# EasyEDA Pro project Zero_PCB_JLCEDA.eprj, schematic Zero_PCB
Create Date: 2023-06-04; Page Name: Zero_PCB; Project Name: Zero_PCB_JLCEDA; Schematic Name: Zero_PCB; Update Date: 2023-07-14; Company: xddcore; Drawed: xddcore; Page Size: A1; Version: V1.1
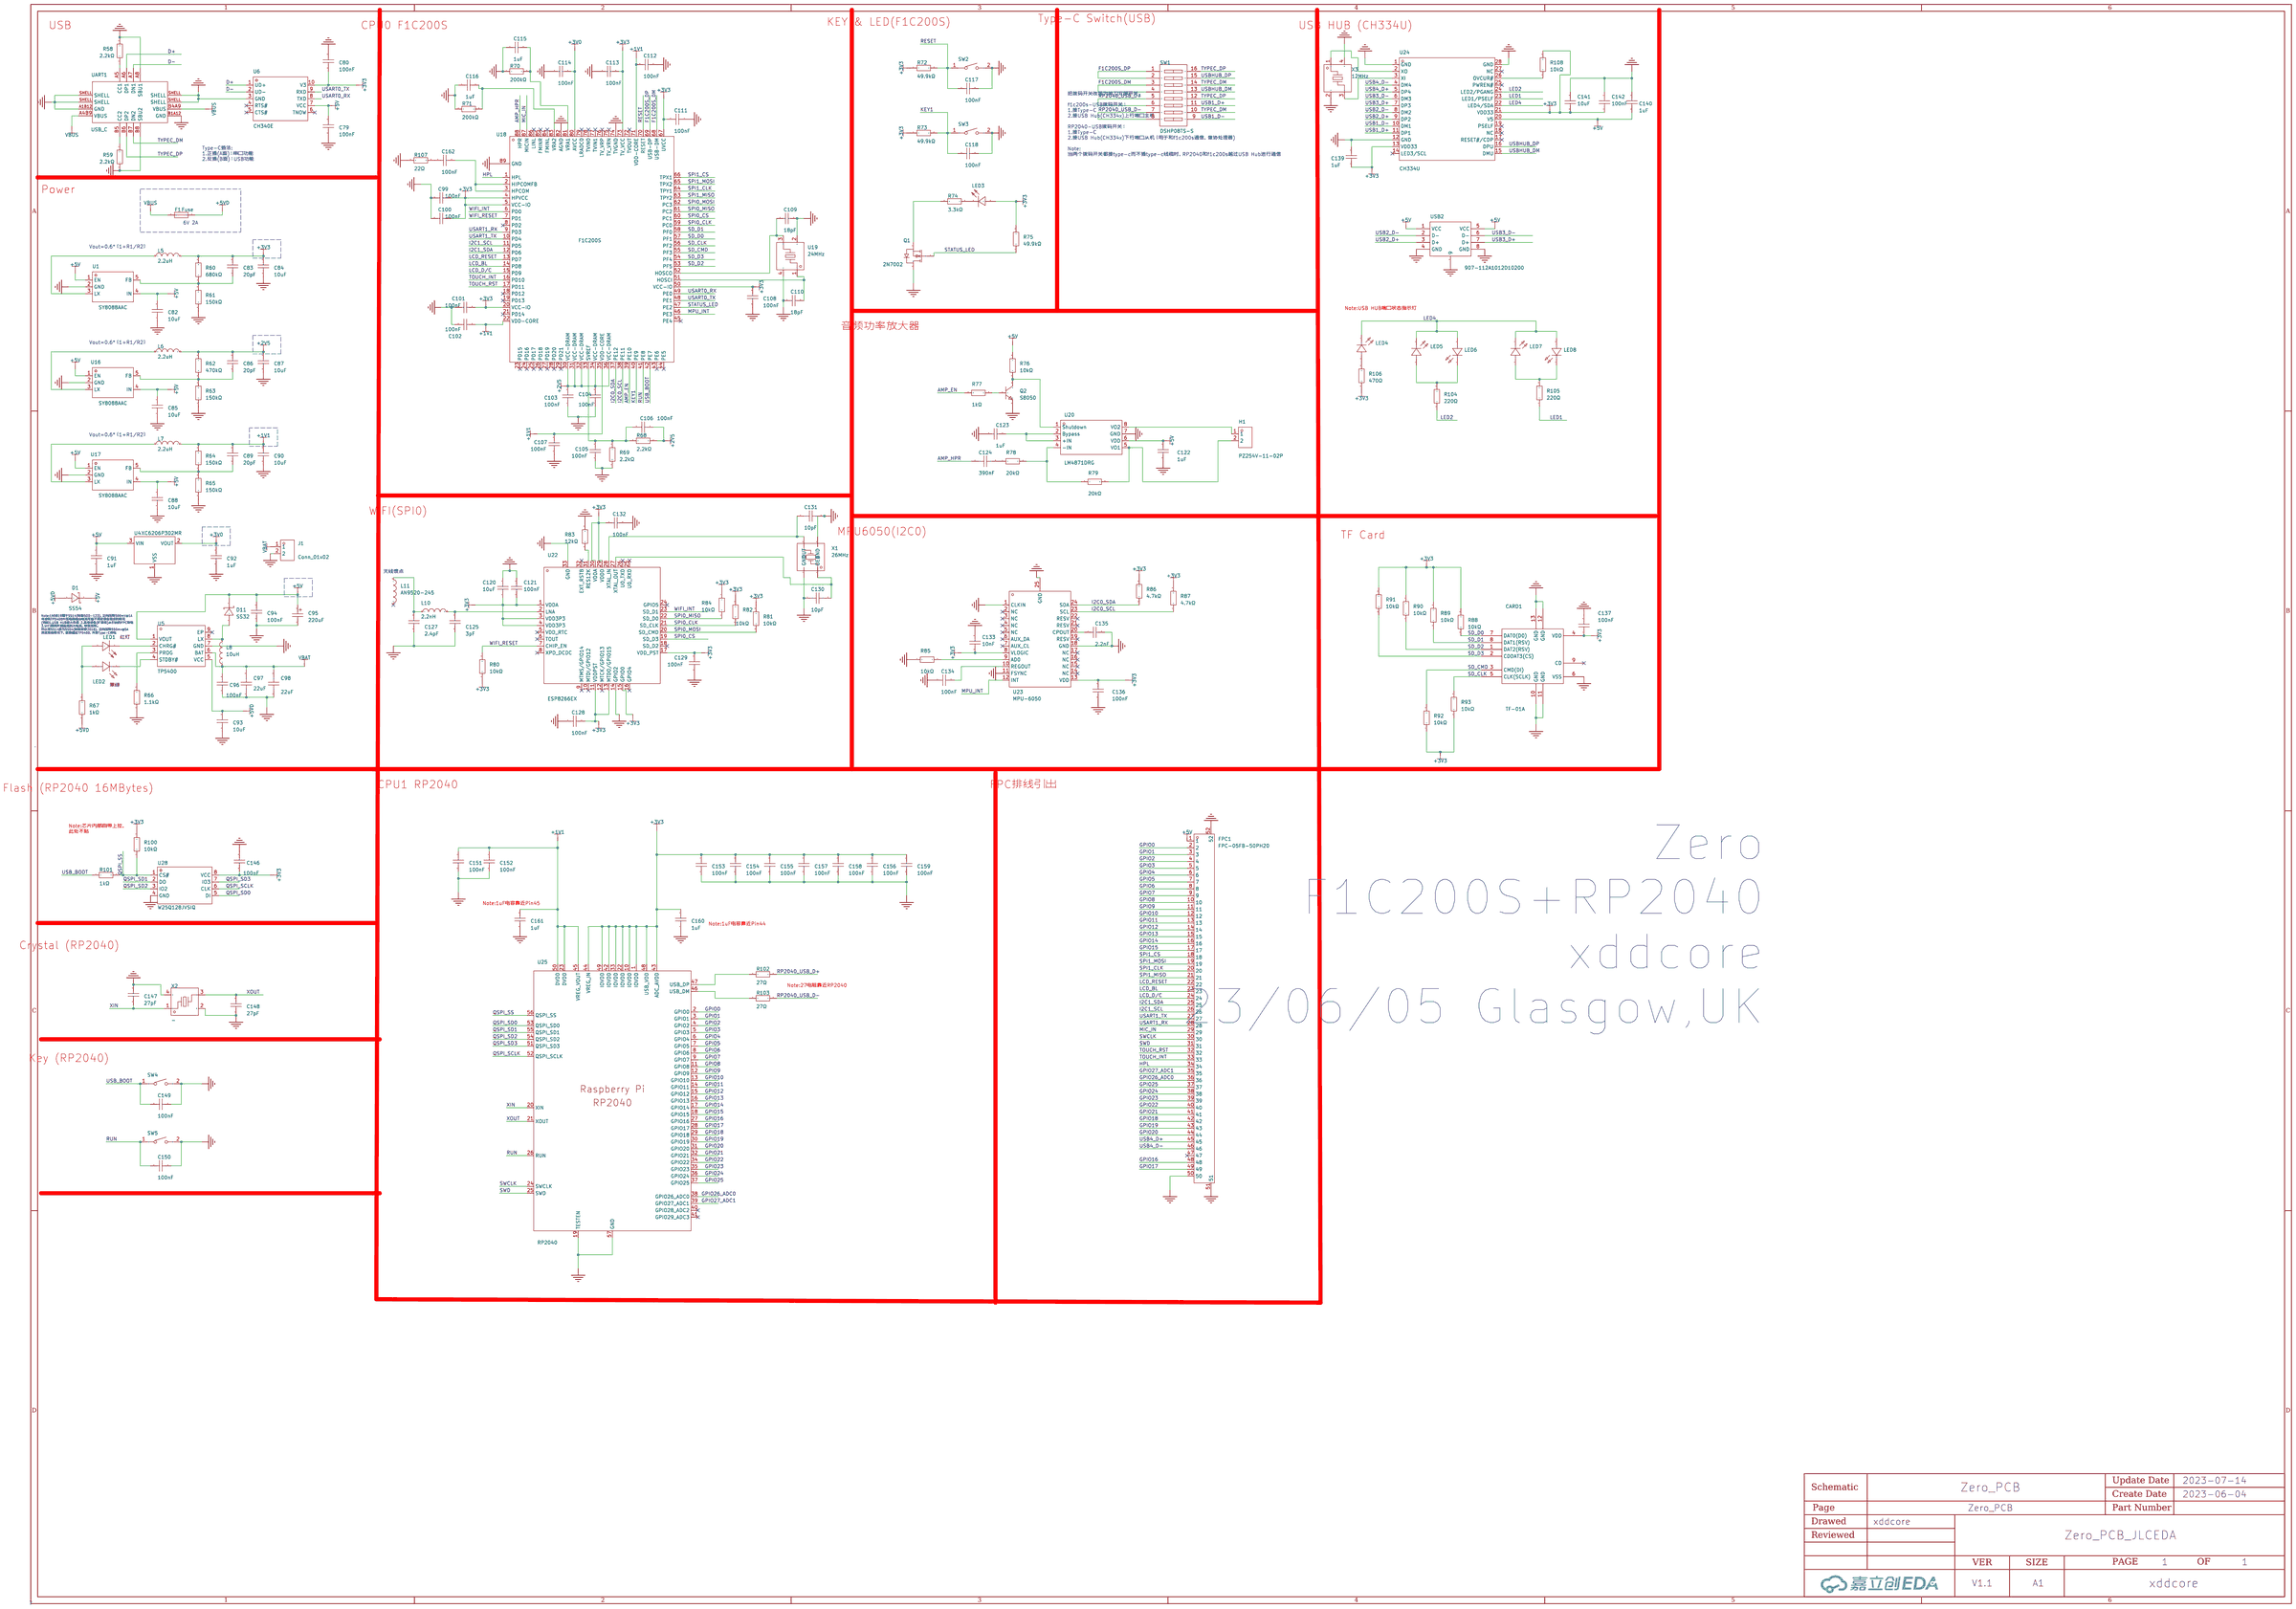
[diagram p0: schematic sheet]

## Parts
C79  100nF  [C0402]
C80  100nF  [C0402]
C82  10uF  [C0402]
C83  20pF  [C0402]
C84  10uF  [C0402]
C85  10uF  [C0402]
C86  20pF  [C0402]
C87  10uF  [C0402]
C88  10uF  [C0402]
C89  20pF  [C0402]
C90  10uF  [C0402]
C91  1uF  [C0402]
C92  1uF  [C0402]
C93  10uF  [C0402]
C94  100nF  [C0402]
C95  220uF  [CASE-D_7343]
C96  100nF  [C0402]
C97  22uF  [C0402]
C98  22uF  [C0402]
C99  100nF  [C0402]
C100  100nF  [C0402]
C101  100nF  [C0402]
C102  100nF  [C0402]
C103  100nF  [C0402]
C104  100nF  [C0402]
C105  100nF  [C0402]
C106  100nF  [C0402]
C107  100nF  [C0402]
C108  100nF  [C0402]
C109  18pF  [C0402]
C110  18pF  [C0402]
C111  100nF  [C0402]
C112  100nF  [C0402]
C113  100nF  [C0402]
C114  100nF  [C0402]
C115  1uF  [C0402]
C116  1uF  [C0402]
C117  100nF  [C0402]
C118  100nF  [C0402]
C120  10uF  [C0402]
C121  100nF  [C0402]
C122  1uF  [C0402]
C123  1uF  [C0402]
C124  390nF  [C0402]
C125  3pF  [C0402]
C127  2.4pF  [C0402]
C128  100nF  [C0402]
C129  100nF  [C0402]
C130  10pF  [C0402]
C131  10pF  [C0402]
C132  100nF  [C0402]
C133  10nF  [C0402]
C134  100nF  [C0402]
C135  2.2nF  [C0402]
C136  100nF  [C0402]
C137  100nF  [C0402]
C139  1uF  [C0402]
C140  1uF  [C0402]
C141  10uF  [C0402]
C142  100nF  [C0402]
C146  100nF  [C0402]
C147  27pF  [C0402]
C148  27pF  [C0402]
C149  100nF  [C0402]
C150  100nF  [C0402]
C151  100nF  [C0402]
C152  100nF  [C0402]
C153  100nF  [C0402]
C154  100nF  [C0402]
C155  100nF  [C0402]
C156  100nF  [C0402]
C157  100nF  [C0402]
C158  100nF  [C0402]
C159  100nF  [C0402]
C160  1uF  [C0402]
C161  1uF  [C0402]
C162  100nF  [C0402]
CARD1  TF-01A  [TF-SMD_TF-01A]
D1  SS54  [SMA_L4.4-W2.8-LS5.4-R-RD]
D11  SS32  [SMA_L4.3-W2.6-LS5.2-RD]
F1  Fuse  [F1206]
FPC1  FPC-05FB-50PH20  [FPC-SMD_50P-P0.50_FPC-05FB-50PH20]
H1  PZ254V-11-02P  [HDR-TH_2P-P2.54-V-M]
J1  Conn_01x02  [CONN-TH_2P-P2.50_HX25003-2A]
L5  2.2uH  [L0402]
L6  2.2uH  [L0402]
L7  2.2uH  [L0402]
L8  10uH  [IND-SMD_L1.0-W0.5-2]
L10  2.2nH  [IND-SMD_L1.0-W0.6]
L11  AN9520-245  [ANT-SMD_L9.5-W2.1]
LED1  NCD0402R1  [LED0402-RD]
LED2  XL-1005UGC  [LED0402-RD_GREEN]
LED3  NCD0402B1  [LED0402-R-RD]
LED4  XL-1005UGC  [LED0402-RD_GREEN]
LED5  XL-1005UGC  [LED0402-RD_GREEN]
LED6  XL-1005UGC  [LED0402-RD_GREEN]
LED7  XL-1005UGC  [LED0402-RD_GREEN]
LED8  XL-1005UGC  [LED0402-RD_GREEN]
Q1  2N7002  [SOT-23-3_L2.9-W1.3-P1.90-LS2.4-BR]
Q2  S8050  [SOT-23-3_L2.9-W1.6-P1.90-LS2.8-BR]
R58  2.2kΩ  [R0402]
R59  2.2kΩ  [R0402]
R60  680kΩ  [R0402]
R61  150kΩ  [R0402]
R62  470kΩ  [R0402]
R63  150kΩ  [R0402]
R64  150kΩ  [R0402]
R65  150kΩ  [R0402]
R66  1.1kΩ  [R0402]
R67  1kΩ  [R0402]
R68  2.2kΩ  [R0402]
R69  2.2kΩ  [R0402]
R70  200kΩ  [R0402]
R71  200kΩ  [R0402]
R72  49.9kΩ  [R0402]
R73  49.9kΩ  [R0402]
R74  3.3kΩ  [R0402]
R75  49.9kΩ  [R0402]
R76  10kΩ  [R0402]
R77  1kΩ  [R0402]
R78  20kΩ  [R0402]
R79  20kΩ  [R0402]
R80  10kΩ  [R0402]
R81  10kΩ  [R0402]
R82  10kΩ  [R0402]
R83  12kΩ  [R0402]
R84  10kΩ  [R0402]
R85  10kΩ  [R0402]
R86  4.7kΩ  [R0402]
R87  4.7kΩ  [R0402]
R88  10kΩ  [R0402]
R89  10kΩ  [R0402]
R90  10kΩ  [R0402]
R91  10kΩ  [R0402]
R92  10kΩ  [R0402]
R93  10kΩ  [R0402]
R100  10kΩ  [R0402]
R101  1kΩ  [R0402]
R102  27Ω  [R0402]
R103  27Ω  [R0402]
R104  220Ω  [R0402]
R105  220Ω  [R0402]
R106  470Ω  [R0402]
R107  22Ω  [R0402]
R108  10kΩ  [R0402]
SW1  DSHP08TS-S  [SW-SMD_DSHP08TS-S]
SW2  TS-1088-AR02016  [SW-SMD_L3.9-W3.0-P4.45]
SW3  TS-1088-AR02016  [SW-SMD_L3.9-W3.0-P4.45]
SW4  TS-1088-AR02016  [SW-SMD_L3.9-W3.0-P4.45]
SW5  TS-1088-AR02016  [SW-SMD_L3.9-W3.0-P4.45]
U1  SY8088AAC  [SOT-23-5_L3.0-W1.7-P0.95-LS2.8-BR]
U4  XC6206P302MR  [SOT-23-3_L3.0-W1.7-P0.95-LS2.9-BR]
U5  TP5400  [ESOP-8_L4.9-W3.9-P1.27-LS6.0-BL-EP]
U6  CH340E  [MSOP-10_L3.0-W3.0-P0.50-LS5.0-BL]
U16  SY8088AAC  [SOT-23-5_L3.0-W1.7-P0.95-LS2.8-BR]
U17  SY8088AAC  [SOT-23-5_L3.0-W1.7-P0.95-LS2.8-BR]
U18  F1C200S  [QFN-88_L10.0-W10.0-P0.40-BL-EP6.75]
U19  24MHz  [CRYSTAL-SMD_4P-L3.2-W2.5-BL]
U20  LM4871DRG  [SOP-8_L4.9-W3.9-P1.27-LS6.0-BL]
U22  ESP8266EX  [QFN-32_L5.0-W5.0-P0.50-BL-EP3.7]
U23  MPU-6050  [QFN-24_L4.0-W4.0-P0.50-BL-EP2.7]
U24  CH334U  [QSOP-28_L9.9-W3.9-P0.64-LS6.0-BL]
U25  RP2040  [LQFN-56_L7.0-W7.0-P0.4-EP]
U28  W25Q128JVSIQ  [SOIC-8_L5.3-W5.3-P1.27-LS8.0-BL]
UART1  USB_C  [USB-3.1-SMD_U262-161N-4BVC11]
USB2  907-112A1012D10200  [USB-A-TH_USB-M-51]
X1  26MHz  [CRYSTAL-SMD_4P-L3.2-W2.5-BL]
X2  -  [OSC-SMD_4P-L2.5-W2.0-BL]
X3  -  [OSC-SMD_4P-L2.5-W2.0-BL]

## Library data of the parts
C79 C80 C94 C96 C99-C108 C111-C114 C117 C118 C121 C128 C129 C132 C134 C136 C137 C142 C146 C149-C159 = 0402B104K160NT: 容值:100nF;精度:±10%;额定电压:16V;材质(温度系数):X7R;; LCSC Part Name: 100nF ±10% 16V; Supplier Part: C41851; Manufacturer: FH(风华); Supplier Footprint: 0402; JLCPCB Part Class: Extended Part; Datasheet: https://atta.szlcsc.com/upload/public/pdf/source/20170923/C41851_1506149456453988767.pdf; Supplier: LCSC; Tolerance: ±10%; Voltage Rated: 16V; Temperature Coefficient: X7R
C82 C84 C85 C87 C88 C90 C93 C120 C141 = CL05A106MQ5NUNC: 容值:10uF;精度:±20%;额定电压:6.3V;材质(温度系数):X5R;; LCSC Part Name: 10uF ±20% 6.3V; Supplier Part: C15525; Manufacturer: SAMSUNG(三星); Supplier Footprint: 0402; JLCPCB Part Class: Basic Part; Datasheet: https://atta.szlcsc.com/upload/public/pdf/source/20220823/2B02EE04F8F211D38A52DCB16EB6BEBA.pdf; Supplier: LCSC; Tolerance: ±20%; Voltage Rated: 6.3V; Temperature Coefficient: X5R
C83 C86 C89 = 0402CG200J500NT: 容值:20pF;精度:±5%;额定电压:50V;材质(温度系数):C0G;; LCSC Part Name: 20pF ±5% 50V; Supplier Part: C1554; Manufacturer: FH(风华); Supplier Footprint: 0402; JLCPCB Part Class: Basic Part; Datasheet: https://atta.szlcsc.com/upload/public/pdf/source/20170923/C1554_1506149268708988361.pdf; Supplier: LCSC; Tolerance: ±5%; Voltage Rated: 50V; Temperature Coefficient: C0G
C91 C92 C115 C116 C122 C123 C139 C140 C160 C161 = CL05A105KP5NNNC: 容值:1uF;精度:±10%;额定电压:10V;材质(温度系数):X5R;; LCSC Part Name: 1uF ±10% 10V; Supplier Part: C14445; Manufacturer: SAMSUNG(三星); Supplier Footprint: 0402; JLCPCB Part Class: Extended Part; Datasheet: https://atta.szlcsc.com/upload/public/pdf/source/20160103/1457707670698.pdf; Supplier: LCSC; Tolerance: ±10%; Voltage Rated: 10V; Temperature Coefficient: X5R
C95 = TAJD227K010RNJ: 容值:220uF;精度:±10%;额定电压:10V;等效串联电阻:500mΩ@100kHz;; LCSC Part Name: 220uF ±10% 10V; Supplier Part: C8024; Manufacturer: Kyocera AVX; Supplier Footprint: CASE-D-7343; JLCPCB Part Class: Extended Part; Datasheet: https://atta.szlcsc.com/upload/public/pdf/source/20160107/1457707750208.pdf; Supplier: LCSC; Tolerance: ±10%; Rated Voltage: 10V; Equivalent Series Resistance(ESR): 500mΩ@100kHz; Operating Temperature: -55℃~+125℃
C97 C98 = GRM155R60J226ME11D: 容值:22uF;精度:±20%;额定电压:6.3V;材质(温度系数):X5R;; LCSC Part Name: 22uF ±20% 6.3V; Supplier Part: C415703; Manufacturer: muRata(村田); Supplier Footprint: 0402; JLCPCB Part Class: Extended Part; Datasheet: https://atta.szlcsc.com/upload/public/pdf/source/20190827/C415703_6BD0543632F9EB034FD8CEA701B6BD0C.pdf; Supplier: LCSC; Tolerance: ±20%; Voltage Rated: 6.3V; Temperature Coefficient: X5R
C109 C110 = 0402CG180J500NT: 容值:18pF;精度:±5%;额定电压:50V;材质(温度系数):C0G;; LCSC Part Name: 18pF ±5% 50V; Supplier Part: C1549; Manufacturer: FH(风华); Supplier Footprint: 0402; JLCPCB Part Class: Basic Part; Datasheet: https://atta.szlcsc.com/upload/public/pdf/source/20170923/C1549_1506149266585988356.pdf; Supplier: LCSC; Tolerance: ±5%; Voltage Rated: 50V; Temperature Coefficient: C0G
C124 = GRM155R61A394KE15D: 容值:390nF;精度:±10%;额定电压:10V;材质(温度系数):X5R;; LCSC Part Name: 390nF ±10% 10V; Supplier Part: C350937; Manufacturer: muRata(村田); Supplier Footprint: 0402; JLCPCB Part Class: Extended Part; Datasheet: https://atta.szlcsc.com/upload/public/pdf/source/20190108/C350937_A04B7346BDA47575F1057169ABDB41DA.pdf; Supplier: LCSC; Tolerance: ±10%; Voltage Rated: 10V; Temperature Coefficient: X5R
C125 = 0402CG3R0C500NT: 容值:3pF;额定电压:50V;材质(温度系数):C0G;; LCSC Part Name: 3pF 50V ±0.25pF; Supplier Part: C1564; Manufacturer: FH(风华); Supplier Footprint: 0402; JLCPCB Part Class: Extended Part; Datasheet: https://atta.szlcsc.com/upload/public/pdf/source/20170923/C1564_1506149273247988371.pdf; Supplier: LCSC; Voltage Rated: 50V; Temperature Coefficient: C0G
C127 = GJM1555C1H2R4WB01D: 容值:2.4pF;额定电压:50V;材质(温度系数):C0G;; LCSC Part Name: 2.4pF 50V; Supplier Part: C88889; Manufacturer: muRata(村田); Supplier Footprint: 0402; JLCPCB Part Class: Extended Part; Datasheet: https://atta.szlcsc.com/upload/public/pdf/source/20161125/1480067938451.pdf; Supplier: LCSC; Voltage Rated: 50V; Temperature Coefficient: C0G
C130 C131 = CL05C100JB5NNNC: 容值:10pF;精度:±5%;额定电压:50V;材质(温度系数):C0G;; LCSC Part Name: 10pF ±5% 50V; Supplier Part: C32949; Manufacturer: SAMSUNG(三星); Supplier Footprint: 0402; JLCPCB Part Class: Basic Part; Datasheet: https://atta.szlcsc.com/upload/public/pdf/source/20160103/1457707722238.pdf; Supplier: LCSC; Tolerance: ±5%; Voltage Rated: 50V; Temperature Coefficient: C0G
C133 = CL05B103KB5NNNC: 容值:10nF;精度:±10%;额定电压:50V;材质(温度系数):X7R;; LCSC Part Name: 10nF ±10% 50V; Supplier Part: C15195; Manufacturer: SAMSUNG(三星); Supplier Footprint: 0402; JLCPCB Part Class: Basic Part; Datasheet: https://atta.szlcsc.com/upload/public/pdf/source/20160103/1457707674468.pdf; Supplier: LCSC; Tolerance: ±10%; Voltage Rated: 50V; Temperature Coefficient: X7R
C135 = 0402B222K500NT: 容值:2.2nF;精度:±10%;额定电压:50V;材质(温度系数):X7R;; LCSC Part Name: 2.2nF ±10% 50V; Supplier Part: C1531; Manufacturer: FH(风华); Supplier Footprint: 0402; JLCPCB Part Class: Basic Part; Datasheet: https://atta.szlcsc.com/upload/public/pdf/source/20170923/C1531_1506149258433988338.pdf; Supplier: LCSC; Tolerance: ±10%; Voltage Rated: 50V; Temperature Coefficient: X7R
C147 C148 = 0402CG270J500NT: 容值:27pF;精度:±5%;额定电压:50V;材质(温度系数):C0G;; LCSC Part Name: 27pF ±5% 50V; Supplier Part: C1557; Manufacturer: FH(风华); Supplier Footprint: 0402; JLCPCB Part Class: Basic Part; Datasheet: https://atta.szlcsc.com/upload/public/pdf/source/20170923/C1557_1506149270123988364.pdf; Supplier: LCSC; Tolerance: ±5%; Voltage Rated: 50V; Temperature Coefficient: C0G
C162 = CL05B104KO5NNNC: 容值:100nF;精度:±10%;额定电压:16V;材质(温度系数):X7R;; LCSC Part Name: 100nF ±10% 16V; Supplier Part: C1525; Manufacturer: SAMSUNG(三星); Supplier Footprint: 0402; JLCPCB Part Class: Basic Part; Datasheet: https://atta.szlcsc.com/upload/public/pdf/source/20160103/1457707674891.pdf; Supplier: LCSC; Tolerance: ±10%; Voltage Rated: 16V; Temperature Coefficient: X7R
CARD1 = TF-01A_C91145: 工作温度范围:-;本体最大高度:-;触头镀层:-;连接器类型:卡座;卡类型:MicroSD卡(TF卡);焊接温度(最大值):-;触头材质:-;卡连接方式:自弹式;; Supplier Part: C91145; Manufacturer: 韩国韩荣; Supplier Footprint: SMD; JLCPCB Part Class: Extended Part; Datasheet: https://atta.szlcsc.com/upload/public/pdf/source/20190322/C91145_63CBD6FB4639A3A3EC6A9721F18AE0FB.pdf; Supplier: LCSC; Connector Type: 卡座; Card Type: MicroSD卡(TF卡); Card Connection Mode: 自弹式
D1 = SS54_C22452: 直流反向耐压(Vr):40V;平均整流电流(Io):5A;正向压降(Vf):550mV@5A;; LCSC Part Name: 40V 5A 550mV@5A; Supplier Part: C22452; Manufacturer: MDD; Supplier Footprint: SMA(DO-214AC); JLCPCB Part Class: Basic Part; Datasheet: https://atta.szlcsc.com/upload/public/pdf/source/20230314/529CD85F9B31F69841D3A079BC07E377.pdf; Supplier: LCSC; Reverse Voltage (Vr): 40V; Average Rectified Current (Io): 5A; Forward Voltage (Vf@If): 550mV@5A; User doc link: http://www.vishay.com/docs/88525/1n5817.pdf
D11 = SS32_C34897: 直流反向耐压（Vr）:20V;平均整流电流（Io）:3A;正向压降（Vf）:500mV @ 3A;; Supplier Part: C34897; Manufacturer: MDD; Supplier Footprint: SMA(DO-214AC); JLCPCB Part Class: Extended Part; Datasheet: https://atta.szlcsc.com/upload/public/pdf/source/20140815/1457707219782.pdf; Supplier: LCSC
F1 = BSMD1206-200-6V: 最大电压:6V;最大电流:100A;保持电流:2A;跳闸电流:3.5A;; LCSC Part Name: 6V 2A 1206自恢复 1.5秒内动作; Supplier Part: C883134; Manufacturer: BHFUSE(佰宏); Supplier Footprint: 1206; JLCPCB Part Class: Extended Part; Datasheet: https://atta.szlcsc.com/upload/public/pdf/source/20220607/BE3D288249A8A8FEF08AA69BF9FC830E.pdf; Supplier: LCSC; Operating Voltage (Max): 6V; Current Rating (Max): 100A; Hold Current: 2A; Trip Current: 3.5A; Power Dissipation: 800mW; Resistance - Initial (Ri) (Min): 15mΩ; Resistance - Post Trip (R1) (Max): 80mΩ; Maximum Time to Trip: 1.5s; Operating Temperature: -40℃~+85℃
FPC1 = FPC-05FB-50PH20: LCSC Part Name: 50P 0.5mm; Supplier Part: C2856838; Manufacturer: XUNPU(讯普); Supplier Footprint: SMD; JLCPCB Part Class: Extended Part; Datasheet: https://atta.szlcsc.com/upload/public/pdf/source/20210922/C2856838_347828C5274658FED2C30B32DE7AFA84.pdf; Supplier: LCSC
H1 = PZ254V-11-02P: 排数:单排;总PIN位数:2;间距:2.54mm;插针结构:1x2P;行距:-;安装类型:直插;圆针/方针:方针;额定电流:-;额定电压:-;配合针长度:6mm;塑高:2.5mm;端接针长度:3mm;触头材质:黄铜;触头镀层:-;工作温度范围:-40℃~+105℃;颜色:黑色;; LCSC Part Name: 2.54mm 1x2P 直插 方针; Supplier Part: C492401; Manufacturer: XFCN(兴飞); Supplier Footprint: 直插,P=2.54mm; JLCPCB Part Class: Extended Part; Datasheet: https://atta.szlcsc.com/upload/public/pdf/source/20200309/C492401_A812433581A9B211A7FFA413ADDFF0E5.pdf; Supplier: LCSC; Number of Rows: 单排; Number of Pins: 2; Pitch: 2.54mm; Pin Structure: 1x2P; Mounting Type: 直插; Circluar Pins/Square Pins: 方针; Length of Mating Pin: 6mm; Insulation Height: 2.5mm; Length of End Connection Pin: 3mm; Contact Material: 黄铜; Operating Temperature Range: -40℃~+105℃; Color: 黑色
J1 = HX25003-2A: 参考系列:XH;间距:2.5mm;插针结构:1x2P;排数:1;每排PIN数:2;行距:-;公母:公型插针;安装方式:直插;额定电流:-;工作温度范围:-;; LCSC Part Name: XH 2.5mm 1x2P 直插 母座; Supplier Part: C442299; Manufacturer: HX(红星); Supplier Footprint: 插件,P=2.5mm; JLCPCB Part Class: Extended Part; Datasheet: https://atta.szlcsc.com/upload/public/pdf/source/20191028/C442299_791AF061D32404B3CF2743C2F942DF66.pdf; Supplier: LCSC; Reference Series: XH; Pitch: 2.5mm; Pins Structure: 1x2P; Number of Rows: 1; Number of PINs Per Row: 2; Gender: 公型插针; Mounting Style: 直插
L5-L7 = SDFL1005P2R2KTF: 电感值:2.2uH;精度:±10%;额定电流:10mA;饱和电流(Isat):-;直流电阻(DCR):1.7Ω;; LCSC Part Name: 2.2uH ±10%; Supplier Part: C49067; Manufacturer: Sunlord(顺络); Supplier Footprint: 0402; JLCPCB Part Class: Extended Part; Datasheet: https://atta.szlcsc.com/upload/public/pdf/source/20210816/855F4348312D259031B87CBCF31BE802.pdf; Supplier: LCSC; Tolerance: ±10%; Rated Current: 10mA; DC Resistance (DCR): 1.7Ω; Q @ Freq: 20@10MHz
L8 = LQW15DN100M00D: 类型:-;电感值:10uH;精度:±20%;额定电流:120mA;饱和电流(Isat):120mA;; LCSC Part Name: 10uH ±20% 120mA; Supplier Part: C910650; Manufacturer: muRata(村田); Supplier Footprint: 0402; JLCPCB Part Class: Extended Part; Supplier: LCSC; Tolerance: ±20%; Rated Current: 120mA; Saturation Current (Isat): 120mA; DC Resistance (DCR): 5.405Ω
L10 = LQW15AN2N2C10D: 电感值:2.2nH;额定电流:1A;饱和电流(Isat):-;直流电阻(DCR):27mΩ;; LCSC Part Name: 2.2nH 27mΩ; Supplier Part: C91240; Manufacturer: muRata(村田); Supplier Footprint: 0402; JLCPCB Part Class: Extended Part; Datasheet: https://atta.szlcsc.com/upload/public/pdf/source/20170116/1484561249478.pdf; Supplier: LCSC; Rated Current: 1A; DC Resistance (DCR): 27mΩ; Q @ Freq: 25@250MHz; Frequency - Self Resonant: 14GHz
L11 = AN9520-245: 2.4G陶瓷天线/适用于WIFI蓝牙; Supplier Part: C99665; Manufacturer: rainsun(霖昱微); Supplier Footprint: SMD,2.1x9.5mm; JLCPCB Part Class: Extended Part; Datasheet: https://atta.szlcsc.com/upload/public/pdf/source/20170425/1493115807294.pdf; Supplier: LCSC
LED1 = NCD0402R1: 发光颜色:红灯;; LCSC Part Name: 红灯; Supplier Part: C130719; Manufacturer: 国星光电; Supplier Footprint: 0402; JLCPCB Part Class: Extended Part; Datasheet: https://atta.szlcsc.com/upload/public/pdf/source/20200820/C130719_A72EA5A7FEC83C35856EA0453E4EE775.pdf; Supplier: LCSC; Emitted Color: 红灯
LED2 LED4-LED8 = XL-1005UGC: 发光颜色:翠绿;主波长:516nm;色温:-;功率:80mW;安装方式:正贴;; LCSC Part Name: 正贴; Supplier Part: C2856703; Manufacturer: XINGLIGHT(成兴光); Supplier Footprint: 0402; JLCPCB Part Class: Extended Part; Datasheet: https://atta.szlcsc.com/upload/public/pdf/source/20221102/FF8D6BC2225363A60A01D46BB802F217.pdf; Supplier: LCSC; Emitted Color: 翠绿; Lens Color: 无色透明; Dominant Wavelength: 516nm; Peak Wavelength: 531nm; Forward Current: 25mA; Power Dissipation: 80mW; Viewing Angle: 120°; Mounting Sytle: 正贴; Operating Temperature: -30℃~+85℃
LED3 = NCD0402B1: 发光颜色:蓝灯;; LCSC Part Name: 蓝灯; Supplier Part: C130724; Manufacturer: 国星光电; Supplier Footprint: 0402; JLCPCB Part Class: Extended Part; Datasheet: https://atta.szlcsc.com/upload/public/pdf/source/20200820/C130724_4F54C0E9D8DAD44D7011DC9EC6DBEF20.pdf; Supplier: LCSC; Emitted Color: 蓝灯
Q1 = 2N7002_C8545: 类型:N沟道;漏源电压(Vdss):60V;连续漏极电流(Id):115mA;功率(Pd):200mW;导通电阻(RDS(on)@Vgs,Id):7.5Ω@10V,500mA;阈值电压(Vgs(th)@Id):2.5V@250uA;; LCSC Part Name: N沟道 60V 115mA; Supplier Part: C8545; Manufacturer: CJ(江苏长电/长晶); Supplier Footprint: SOT-23; JLCPCB Part Class: Basic Part; Datasheet: https://atta.szlcsc.com/upload/public/pdf/source/20170302/1488422688078.pdf; Supplier: LCSC; Type: N沟道; Drain Source Voltage (Vdss): 60V; Continuous Drain Current (Id): 115mA; Power Dissipation (Pd): 200mW; Drain Source On Resistance (RDS(on)@Vgs,Id): 7.5Ω@10V,500mA; Gate Threshold Voltage (Vgs(th)@Id): 2.5V@250uA
Q2 = S8050_C105433: 晶体管类型:NPN;集射极击穿电压(Vceo):25V;集电极电流(Ic):500mA;功率(Pd):300mW;直流电流增益(hFE@Ic,Vce):120@50mA,1V;; LCSC Part Name: NPN 25V 500mA L档 120-200; Supplier Part: C105433; Manufacturer: CJ(江苏长电/长晶); Supplier Footprint: SOT-23; JLCPCB Part Class: Extended Part; Datasheet: https://atta.szlcsc.com/upload/public/pdf/source/20170415/1492237762328.pdf; Supplier: LCSC; Transistor Type: NPN; Collector-Emitter Breakdown Voltage (Vceo): 25V; Collector Current (Ic): 500mA; Power Dissipation (Pd): 300mW; Collector Cut-Off Current (Icbo): 100nA; Collector-Emitter Saturation Voltage (VCE(sat)@Ic,Ib): 600mV@500mA,50mA; DC Current Gain (hFE@Ic,Vce): 120@50mA,1V; Transition Frequency (fT): 150MHz; Operating Temperature: +150℃@(Tj)
R58 R59 R68 R69 = 0402WGF2201TCE: 电阻类型:厚膜电阻;阻值:2.2kΩ;精度:±1%;功率:62.5mW;; LCSC Part Name: 2.2kΩ ±1% 62.5mW; Supplier Part: C25879; Manufacturer: UNI-ROYAL(厚声); Supplier Footprint: 0402; JLCPCB Part Class: Basic Part; Datasheet: https://atta.szlcsc.com/upload/public/pdf/source/20200306/C422600_1E6D84923E4A46A82E41ADD87F860B5C.pdf; Supplier: LCSC; Type: 厚膜电阻; Tolerance: ±1%; Power(Watts): 62.5mW; Temperature Coefficient: ±100ppm/℃; Overload Voltage (Max): 50V; Operating Temperature Range: -55℃~+155℃